# EasyEDA Pro project ProPrj_Avaota A1 八核 AIoT 开发板_2024-05-20.epro, board PCB1 (continued)
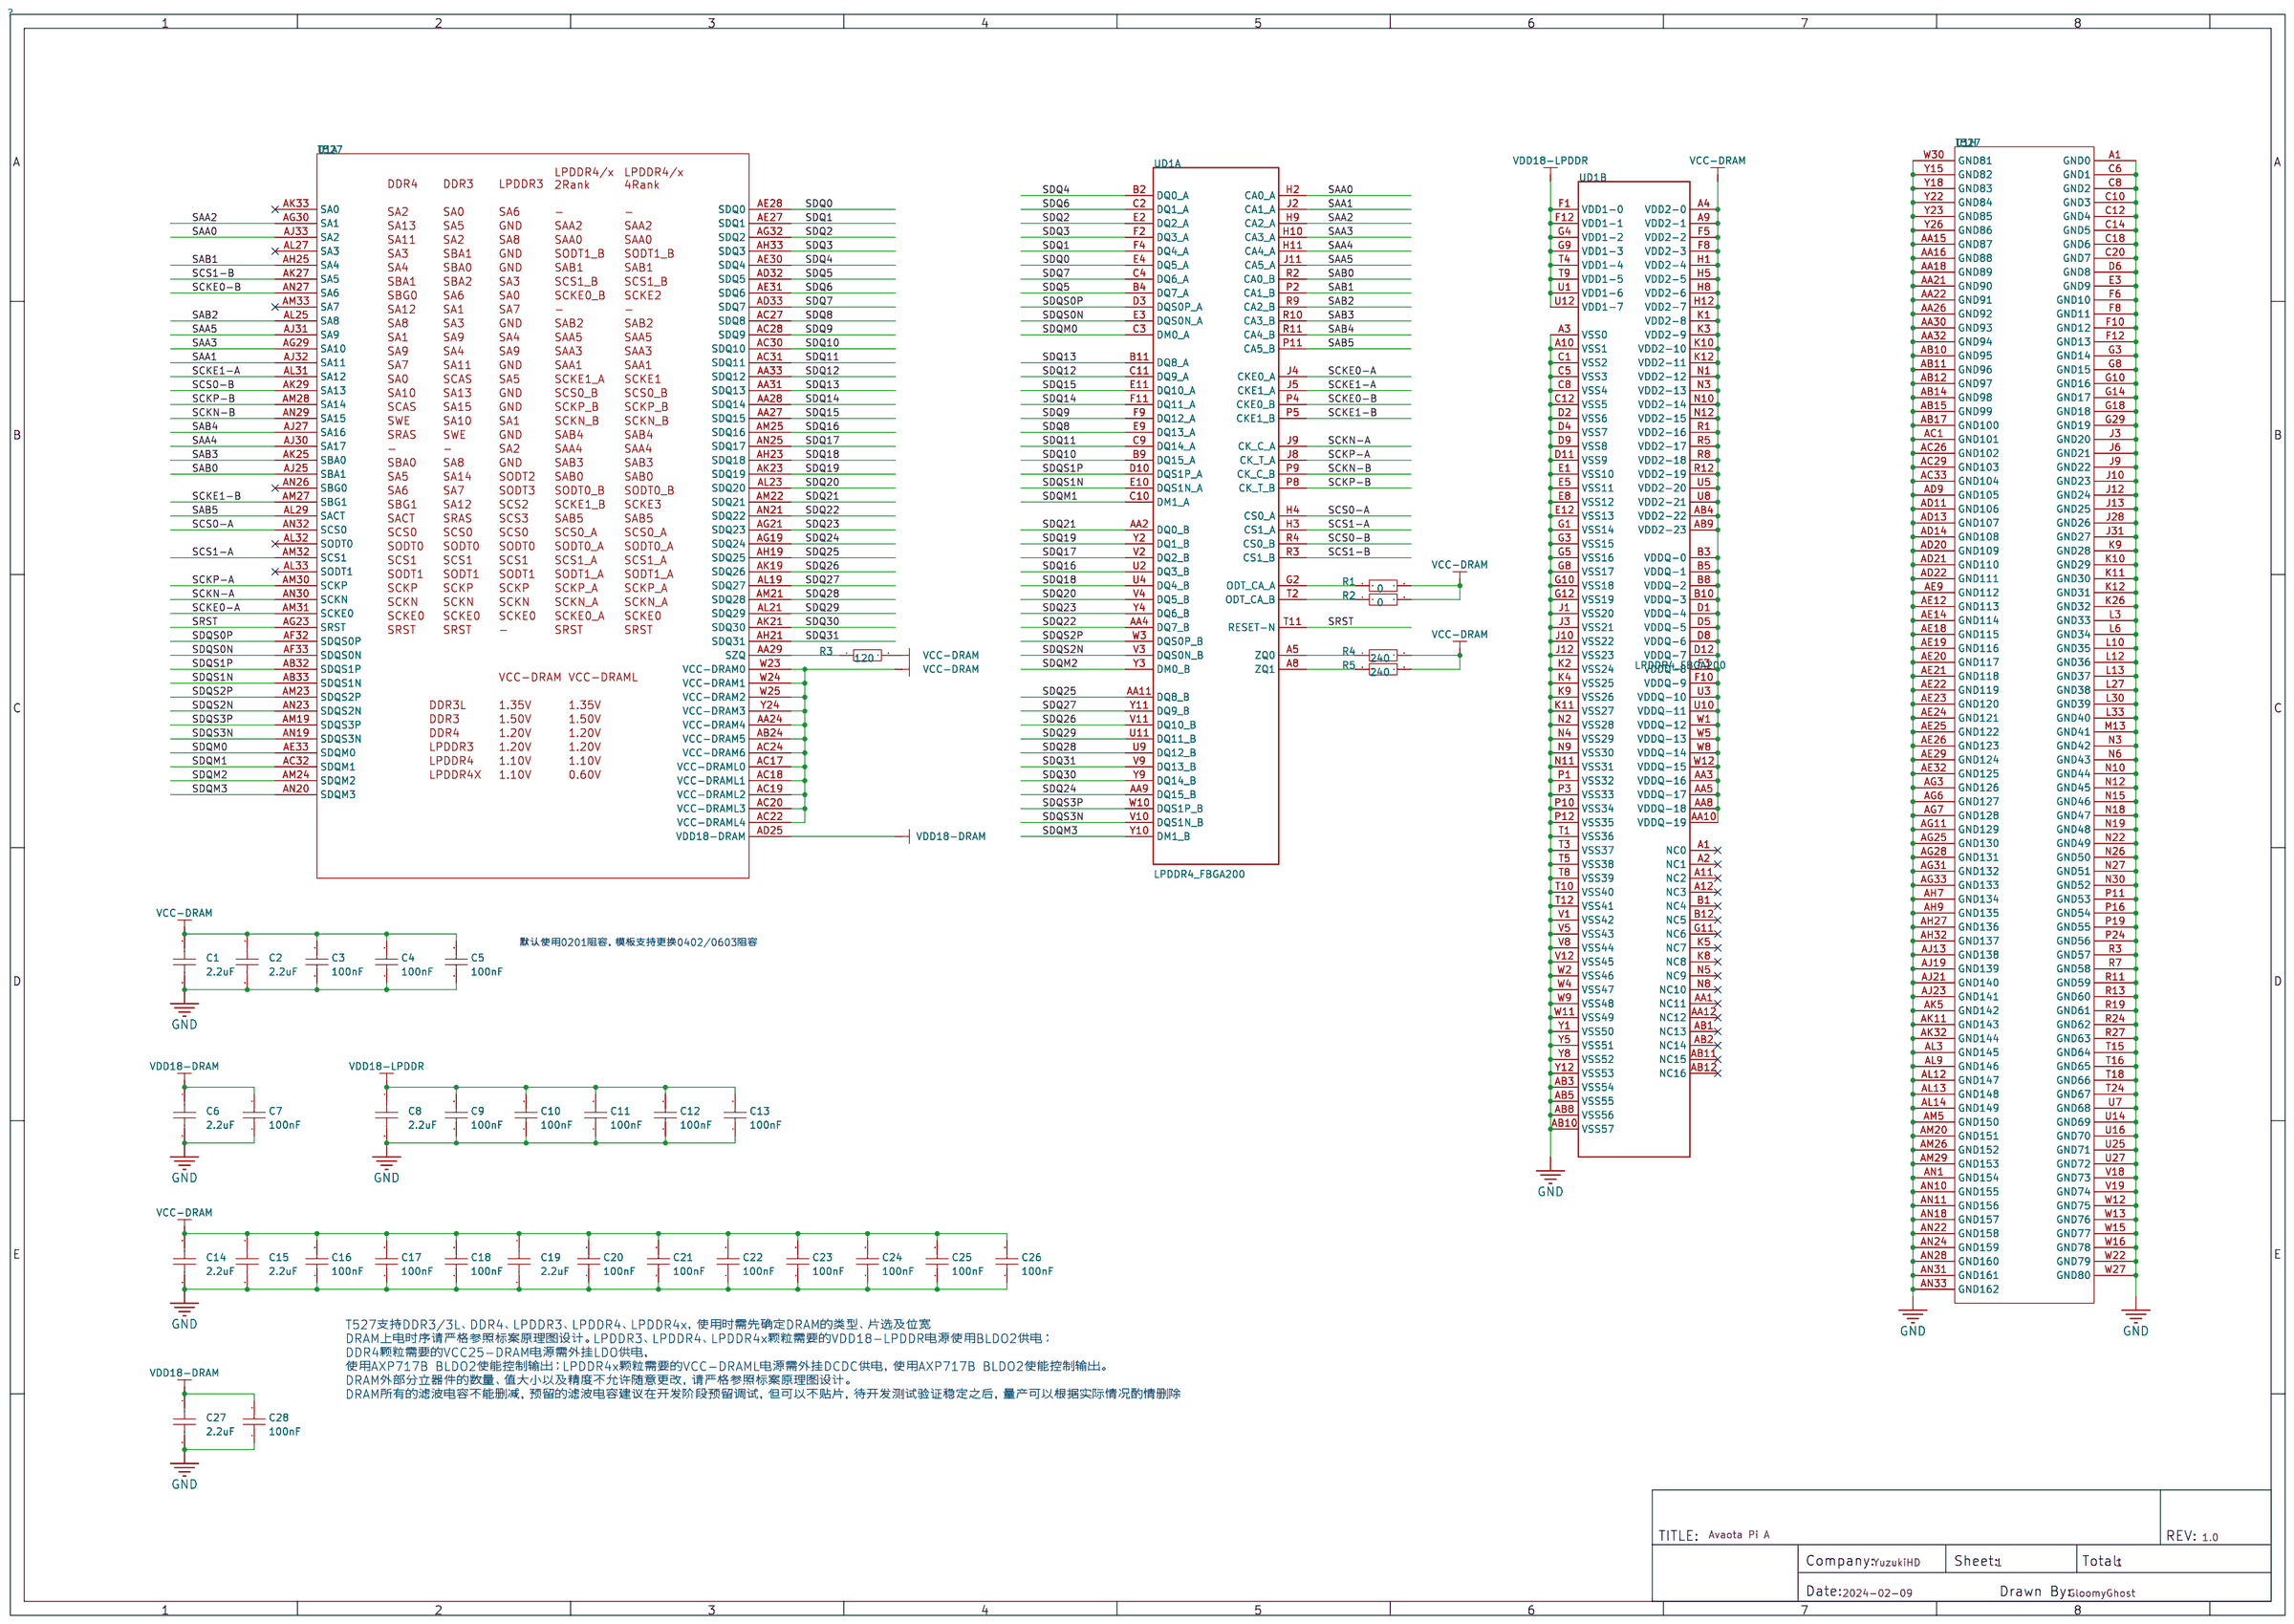
[diagram p0: schematic sheet]
## Routing (per net, layer and track width the routed paths; a pad name or vN(x,y) marks a point on that pad's centre or on a via; arc(x,y) is an arc through that point) (continued)
SDQ3: length 21.4
  Top Layer w0.076: 55.93,40.14 55.7,39.9 55.02,39.9 54.69,39.57 54.48,39.57 v2(53.92,39.01)
  Top Layer w0.115: v2(45.44,39.01) 45.49,39.06 45.49,39.37 45.34,39.52 44.8,39.52 44.68,39.65 44.68,39.93 44.8,40.06 45.79,40.06 46.12,40.39 46.12,40.97 45.74,41.35 45.02,41.35 43.87,42.49 43.39,42.49 43.18,42.71 43.06,42.71 42.95,42.82 42.95,43.21 42.29,43.87 41.72,43.87 41.41,43.55
  内层2 w0.115: v2(45.44,39.01) 45.81,38.64 53.55,38.64 v2(53.92,39.01)
SDQ4: length 18.8
  Top Layer w0.115: 57.43,41.64 57.9,41.64 v2(57.94,41.68) ; 41.41,40.95 41.74,40.61 42.31,40.61 43,39.93 43.68,39.93 v2(44.04,40.29)
  内层2 w0.115: v2(57.94,41.68) 57.83,41.68 57.43,41.27 57.43,40.69 56.69,39.95 53.57,39.95 53.49,40.03 50.7,40.03 50.49,40.23 44.1,40.23 v2(44.04,40.29)
SDQ5: length 21.1
  Top Layer w0.076: 57.93,40.64 57.68,40.39 57.68,40.04 57.55,39.91 57.55,39.42 v2(57.14,39)
  Top Layer w0.115: 40.17,40.62 40.16,40.64 40.11,40.64 39.81,40.95
  内层2 w0.115: v2(57.14,39) 57.14,38.95 55.99,37.8 43.2,37.8 40.42,40.58 40.22,40.58 v2(40.17,40.62)
SDQ6: length 20.8
  Top Layer w0.115: 41.41,41.6 41.75,41.25 42.4,41.25 42.57,41.08 42.57,40.77 42.67,40.67 42.82,40.67 42.9,40.74 42.9,41.13 43.01,41.25 43.14,41.25 43.25,41.13 43.25,40.74 43.34,40.66 43.51,40.66 43.58,40.73 43.58,41.17 43.66,41.25 43.79,41.25 43.89,41.15 43.89,40.67 43.51,40.29 v2(43.36,40.29) ; 57.43,41.14 57.4,41.1 v2(56.97,41.1)
  内层2 w0.115: v2(43.36,40.29) 43.73,40.67 50.95,40.67 51.28,40.33 53.77,40.33 53.92,40.18 56.41,40.18 56.97,40.74 v2(56.97,41.1)
SDQ7: length 23.5
  Top Layer w0.076: v2(57.65,39) 57.65,39.13 57.76,39.24 57.76,39.86 57.86,39.96 57.86,40.07 57.93,40.14
  Top Layer w0.115: 39.81,41.6 39.74,41.6 v2(39.44,41.3)
  内层2 w0.115: v2(57.65,39) 57.65,38.85 56.18,37.38 41.79,37.38 39.5,39.67 39.5,40 39.77,40.28 39.77,40.97 v2(39.44,41.3)
SDQ8: length 28.1
  Top Layer w0.115: 58.43,43.14 58.69,42.88 v2(58.85,42.88) ; UD1.E9 36.35,42.57 36.8,42.57 37.16,42.52 37.49,42.57 v2(37.77,42.87)
  Inner5 w0.115: v2(58.85,42.88) 58.46,42.88 58.34,42.77 58.34,42.29 58.11,42.06 56.82,42.06 56.51,41.76 56.51,40.89 56.38,40.76 52.35,40.76 51.51,41.6 46.97,41.6 46.25,42.32 44.22,42.32 43.91,42.62 43.67,42.62 43.55,42.51 43.55,42.43 43.44,42.32 43.21,42.32 43.09,42.43 43.09,42.51 42.98,42.62 42.36,42.62 42.19,42.44 41.68,42.44 41.2,42.93 41.2,43.34 41.08,43.46 40.85,43.46 40.74,43.34 40.74,43.07 40.63,42.95 39.85,42.95 39.77,42.87 39.14,42.87 38.68,43.33 38.22,43.33 v2(37.77,42.87)
SDQ9: length 28.1
  Top Layer w0.115: 35.81,43.55 35.89,43.46 36.23,43.46 36.46,43.23 37.95,43.23 38.17,43 38.17,42.32 v2(38.56,41.94) ; v2(58.82,42.36) 58.72,42.36 58.43,42.64
  Inner5 w0.115: v2(38.56,41.94) 38.56,42.15 38.67,42.27 39.62,42.27 40.16,41.73 40.99,41.73 41.81,40.92 41.81,40.78 41.92,40.67 42.47,40.67 42.95,41.15 44.06,41.15 44.47,41.55 45.38,41.55 45.49,41.44 45.49,41.3 45.62,41.17 45.74,41.17 45.98,41.41 46.14,41.41 46.78,40.77 51.46,40.77 51.92,40.31 57.68,40.31 58.29,40.92 58.29,41.68 58.82,42.21 v2(58.82,42.36)
SDQ10: length 26.9
  Top Layer w0.076: v2(58.9,41.64) 58.44,41.64 58.43,41.64
  Top Layer w0.115: v2(37.87,40.56) 37.56,40.26 37.06,40.26 36.7,40.61 36.14,40.61 35.81,40.95
  Inner5 w0.115: v2(37.87,40.56) 37.87,40.8 37.98,40.92 39.65,40.92 39.7,40.97 40.59,40.97 40.64,40.92 41.25,40.92 41.43,40.74 41.43,40.4 41.54,40.28 42.68,40.28 43.12,40.73 44.58,40.73 44.69,40.84 44.69,41.06 44.81,41.17 45.03,41.17 45.15,41.06 45.15,40.84 45.26,40.73 46.32,40.73 46.7,40.35 51.29,40.35 51.56,40.08 57.99,40.08 58.52,40.61 58.52,41.33 58.83,41.64 v2(58.9,41.64)
SDQ11: length 26.1
  Top Layer w0.115: v2(58.9,41.1) 58.47,41.1 58.43,41.14 ; v2(38.53,40.56) 38.15,40.94 37.59,40.94 37.28,41.25 36.15,41.25 35.81,41.6
  Inner5 w0.115: v2(38.53,40.56) 38.81,40.56 38.92,40.45 38.92,40.32 39.29,39.96 39.45,39.96 39.7,40.21 40.74,40.21 41.02,39.93 44.37,39.93 44.47,40.03 44.47,40.27 44.59,40.38 44.91,40.38 45.08,40.21 45.51,40.21 45.62,40.31 46.14,40.31 46.25,40.2 46.25,40.03 46.35,39.93 51.14,39.93 51.21,39.85 58.14,39.85 58.9,40.61 v2(58.9,41.1)
SDQ12: length 32.7
  Top Layer w0.115: v2(59.5,39.57) 59.43,39.64 59.43,40.14 ; v2(33.3,39.78) 33.71,40.18 33.71,41.1 34.21,41.6
  Inner5 w0.115: v2(59.5,39.57) 59.76,39.57 60.22,39.12 60.22,38.76 59.84,38.38 59.84,38.12 59.09,37.38 35.7,37.38 v2(33.3,39.78)
SDQ13: length 31.5
  Top Layer w0.076: 59.43,41.14 59.18,40.89 59.18,39.75 59.13,39.7 59.13,39.45 59.27,39.31 ; v2(59.83,38.94) 59.42,39.25 59.27,39.31 ; 59.27,39.31 arc(59.27,39.31) 59.27,39.3
  Top Layer w0.115: v2(34.19,39.78) 33.91,40.05 33.91,40.65 34.21,40.95
  Inner5 w0.115: v2(34.19,39.78) 34.19,39.4 35.79,37.79 59.1,37.79 59.54,38.23 59.54,38.46 59.83,38.75 v2(59.83,38.94)
SDQ14: length 32.5
  Top Layer w0.102: 59.43,42.64 59.89,42.64 v2(59.9,42.65)
  Top Layer w0.115: 34.21,43.55 34.21,43.51 v2(33.88,43.18)
  Inner5 w0.115: v2(59.9,42.65) 59.54,42.29 59.54,40.31 58.62,39.4 52.5,39.4 52.19,39.09 45.9,39.09 45.59,39.4 45.29,39.4 44.98,39.09 37.89,39.09 36.19,40.79 36.19,42.29 35.48,43.01 34.93,43.01 34.85,42.93 34.14,42.93 33.88,43.18
SDQ15: length 31.8
  Top Layer w0.115: 59.43,43.14 59.47,43.18 v2(59.94,43.18) ; 34.21,42.9 34.59,43.28 v2(34.62,43.28)
  Inner5 w0.115: v2(34.62,43.28) 35.66,43.28 36.6,42.34 36.6,40.92 38.02,39.5 44.8,39.5 45.11,39.81 45.76,39.81 46.07,39.51 52.08,39.51 52.19,39.62 58.42,39.62 59.26,40.46 59.26,42.6 59.84,43.18 v2(59.94,43.18)
SDQ16: length 16.7
  Top Layer w0.076: 51.91,43.57 52.91,43.57 53.23,43.89 53.68,43.89 53.93,44.14
  Top Layer w0.115: 51.91,43.57 51.79,43.46 49.27,43.46 v2(47.27,45.47) ; v2(43.38,50.22) 43.26,50.57 43.13,50.75 43.08,50.85 42.85,50.95 42.6,50.9 42.32,51 41.73,50.98 41.71,50.95 UD1.U2
  内层2 w0.115: v2(47.27,45.47) 47.27,45.48 46.04,46.71 46.04,47.64 43.46,50.22 v2(43.38,50.22)
SDQ17: length 16.5
  Top Layer w0.115: v2(43.33,51.36) 43,51.69 41.74,51.69 41.41,51.35 ; v2(48,45.47) 48.03,45.44 48.03,45.26 49.58,43.71 51.69,43.71 51.86,43.89 52.88,43.89 53.13,44.14 53.43,44.14
  内层2 w0.115: v2(48,45.47) 47.88,45.47 46.45,46.89 46.45,47.81 43.33,50.94 v2(43.33,51.36)
SDQ18: length 24.1
  Top Layer w0.076: v2(56.01,44.68) 55.93,44.75 55.93,45.14
  Top Layer w0.115: v2(39.4,51.08) 39.78,50.7 39.81,50.7
  内层2 w0.115: v2(56.01,44.68) 56.01,44.83 55.54,45.3 54.29,45.3 53.62,45.97 53.62,46.35 51.84,48.13 51.46,48.13 46.2,53.39 39.39,53.39 39.14,53.14 39.14,51.34 v2(39.4,51.08)
SDQ19: length 18.9
  Top Layer w0.115: 54.93,45.14 54.96,45.11 v2(54.96,44.68) ; v2(46.73,51.79) 46.06,51.12 43.97,51.12 43.72,51.36 43.72,52.49 43.25,52.96 41.85,52.96 41.54,52.65 41.41,52.65
  内层2 w0.115: v2(46.73,51.79) 46.73,51.78 50.2,48.31 50.54,48.31 53.36,45.49 53.49,45.49 53.92,45.06 54.68,45.06 54.96,44.78 v2(54.96,44.68)
SDQ20: length 21.2
  Top Layer w0.076: v2(39.5,52.98) 39.5,51.66 39.81,51.35
  Top Layer w0.102: 54.43,45.14 v2(54.43,44.68)
  内层2 w0.115: v2(39.5,52.98) 39.52,53.01 45.9,53.01 46.31,52.59 46.31,51.61 50.01,47.92 50.34,47.92 53.02,45.24 53.36,45.24 53.92,44.68 v2(54.43,44.68)
SDQ21: length 17.3
  Top Layer w0.076: v2(51.97,45.47) 52.3,45.8 53.21,45.8 53.31,45.89 53.68,45.89 53.93,45.64
  Top Layer w0.115: 41.41,53.3 41.49,53.3 41.91,53.72 41.91,54.05 42.11,54.25 42.44,54.25 42.85,53.85 43.63,53.85 45.62,51.87 45.73,51.87 45.84,51.75 v2(45.84,51.66)
  内层2 w0.115: v2(45.84,51.66) 45.84,51.48 49.83,47.5 50.11,47.5 51.97,45.64 v2(51.97,45.47)
SDQ22: length 20.7
  Top Layer w0.076: 53.43,46.14 53.3,46.14 53.15,45.99 51.6,45.99
  Top Layer w0.115: v2(51.38,45.47) 51.43,45.47 51.46,45.49 51.46,45.85 51.6,45.99 ; 39.81,53.3 40.16,53.65 40.16,54.51 40.64,54.99 42.8,54.99 43.56,54.23 43.74,54.23 45.41,52.55 v2(45.82,52.55)
  内层2 w0.115: v2(45.82,52.55) 45.43,52.16 45.43,51.31 49.66,47.08 49.94,47.08 51.38,45.63 v2(51.38,45.47)
SDQ23: length 22.2
  Top Layer w0.102: 56.43,46.14 56.43,45.89 ; 56.43,45.89 56.43,45.82 56.53,45.72 v2(56.55,45.72) ; 56.43,45.89 56.43,46.14
  Top Layer w0.115: 39.81,52.65 40,52.65 40.31,52.96 40.71,52.96 40.99,53.24 40.99,53.31 41.3,53.62 41.5,53.62 41.7,53.82 41.7,54.15 42.11,54.56 42.59,54.56 42.69,54.46 v2(42.82,54.46)
  内层2 w0.115: v2(56.55,45.72) 56.12,46.15 54.4,46.15 51.97,48.59 51.59,48.59 45.72,54.46 v2(42.82,54.46)
SDQ24: length 25.9
  Top Layer w0.102: 56.43,47.14 56.43,46.78 v2(56.54,46.68)
  Top Layer w0.115: v2(36.17,53.7) 36.17,53.66 35.81,53.3
  Inner5 w0.115: v2(36.17,53.7) 36.24,53.77 36.6,53.77 36.88,54.05 36.88,54.46 37.41,54.99 45.37,54.99 49.38,50.99 49.38,50.83 51.51,48.69 54.2,48.69 54.51,48.39 54.51,48.37 55.23,47.65 55.78,47.65 56.54,46.89 v2(56.54,46.68)
SDQ25: length 27.2
  Top Layer w0.115: v2(37.69,54.61) 37.39,54.91 35.13,54.91 34.57,54.36 34.57,53.66 34.21,53.3 ; 56.01,47.07 v2(56.01,46.68) ; 56.01,47.07 55.93,47.14
  Inner5 w0.115: v2(37.69,54.61) 38.07,54.23 38.81,54.23 39.04,54.46 40.36,54.46 40.73,54.09 45.68,54.09 48.96,50.81 48.96,50.58 51.13,48.41 53.87,48.41 55.01,47.27 55.52,47.27 56.01,46.79 v2(56.01,46.68)
SDQ26: length 27
  Top Layer w0.102: v2(54.96,46.68) 54.93,46.71 54.93,47.14
  Top Layer w0.115: 34.21,51.35 34.57,51.71 v2(34.57,51.71)
  Inner5 w0.115: v2(54.96,46.68) 54.96,46.73 53.59,48.11 50.84,48.11 48.54,50.41 48.54,50.52 45.39,53.67 40.66,53.67 40.31,54.03 39.09,54.03 38.96,53.9 38.02,53.9 37.79,53.67 36.96,53.67 36.58,53.29 35.18,53.29 35.05,53.42 34.44,53.42 34.21,53.19 34.21,52.07 v2(34.57,51.71)
SDQ27: length 24.4
  Top Layer w0.115: v2(34.59,53.01) 34.57,53.01 34.21,52.65 ; 54.43,47.14 v2(54.43,46.68)
  Inner5 w0.115: v2(54.43,46.68) 53.77,47.35 51.01,47.35 46.95,51.41 46.56,51.41 46.3,51.66 46.3,51.79 46,52.1 45.62,52.1 44.49,53.23 41.95,53.23 41.81,53.37 40.46,53.37 40.1,53.72 39.22,53.72 39.11,53.62 38.07,53.62 37.82,53.37 37.54,53.37 37.41,53.24 37.41,52.98 37.26,52.83 34.77,52.83 v2(34.59,53.01)
SDQ28: length 21.8
  Top Layer w0.076: 51.16,46.33 51.53,46.33 51.69,46.18 53.11,46.18 53.32,46.39 53.68,46.39 53.93,46.14
  Top Layer w0.115: 51.16,46.33 50.37,46.33 50.09,46.05 49.3,46.05 49.15,45.9 48.33,45.9 47.27,46.96 v2(47.27,47.2) ; v2(37.64,50.75) 37.03,50.75 36.75,51.03 36.29,51.03 35.97,50.7 35.81,50.7
  Inner5 w0.115: v2(37.64,50.75) 37.64,50.41 37.75,50.29 38.83,50.29 39.16,49.96 39.62,49.96 39.88,50.22 40.49,50.22 40.69,50.01 41.48,50.01 41.55,49.94 42.03,49.94 42.54,49.43 43.12,49.43 43.47,49.07 43.86,49.07 44.09,49.3 44.39,49.3 44.99,48.7 46.09,48.7 46.63,48.16 46.63,47.82 47.26,47.2 v2(47.27,47.2)
SDQ29: length 25
  Top Layer w0.115: v2(33.8,50.95) 34.06,50.7 34.21,50.7 ; 54.43,46.14 v2(54.43,45.68)
  Inner5 w0.115: v2(54.43,45.68) 53.96,45.68 53.76,45.88 52.59,45.88 52.18,46.29 48.19,46.29 47.78,46.71 47.14,46.71 45.57,48.29 44.3,48.29 43.93,48.65 43.3,48.65 42.95,49.01 42.45,49.01 41.91,49.56 41.43,49.56 41.25,49.73 40.59,49.73 40.36,49.96 40,49.96 39.78,49.73 39.04,49.73 38.81,49.5 36.68,49.5 36.5,49.33 34.3,49.33 34.19,49.44 34.19,50.57 v2(33.8,50.95)
SDQ30: length 23.2
  Top Layer w0.102: v2(38.48,52.55) 38.45,52.58 37.72,52.58 37.36,52.93 36.96,52.86 36.78,52.93 36.4,52.93 36.22,52.76 35.91,52.76 35.81,52.65 ; 54.93,46.14 54.93,45.71 v2(54.96,45.68)
  Inner5 w0.115: v2(54.96,45.68) 54.59,46.05 53.95,46.05 53.74,46.25 52.65,46.25 52.25,46.66 50.51,46.66 46.72,50.44 45.81,50.44 44.29,51.97 41.65,51.97 41.4,52.22 41.4,52.55 41.22,52.73 40.49,52.73 40.23,52.48 39.04,52.48 38.96,52.55 v2(38.48,52.55)
SDQ31: length 24.9
  Top Layer w0.115: 35.81,51.35 36.13,51.35 36.47,51.68 37.31,51.68 37.79,52.17 v2(37.79,52.2) ; v2(56.01,45.68) 56.01,46.07
  Inner5 w0.115: v2(56.01,45.68) 56.01,45.77 55.5,46.28 54.23,46.28 53.49,47.02 50.75,47.02 46.81,50.95 45.89,50.95 44.04,52.81 41.78,52.81 41.53,53.06 40.18,53.06 39.85,53.39 39.29,53.39 39.01,53.11 39.01,53.02 38.9,52.91 38.28,52.91 37.79,52.43 v2(37.79,52.2)
SDQM0: length 19.5
  Top Layer w0.076: v2(56.61,39) 57.35,39.74 57.39,39.97 57.43,40.15
  Top Layer w0.115: 40.61,41.6 40.89,41.31 v2(40.89,41.27)
  内层2 w0.115: v2(56.61,39) 56.6,39 56.6,38.95 55.87,38.22 43.49,38.22 41.68,40.03 41.68,40.41 40.89,41.2 v2(40.89,41.27)
SDQM1: length 26.3
  Top Layer w0.115: 58.43,40.64 58.43,40.65 v2(57.94,41.15) ; v2(37.89,41.94) 37.77,41.81 37.01,41.81 36.9,41.91 35.63,41.91 35.32,41.6 35.01,41.6
  Inner5 w0.115: v2(37.89,41.94) 37.74,42.09 37.74,42.32 38.05,42.62 39.65,42.62 40.13,42.14 41.09,42.14 42.06,41.17 42.44,41.17 42.83,41.56 43.98,41.56 44.35,41.94 46.15,41.94 46.9,41.19 51.55,41.19 52.19,40.54 57.33,40.54 v2(57.94,41.15)
SDQM2: length 19.9
  Top Layer w0.076: 51.79,44.14 52.78,44.14 53.02,44.39 53.68,44.39 53.93,44.64
  Top Layer w0.115: 51.79,44.14 51.64,44.14 51.46,43.97 49.75,43.97 48.54,45.18 v2(48.54,45.47) ; 40.61,52.65 40.71,52.65 41.02,52.96 41.53,52.96 41.78,53.21 41.78,53.28 42.13,53.62 42.39,53.62 42.62,53.39 43.46,53.39 44.14,52.7 v2(44.14,51.54)
  内层2 w0.115: v2(44.14,51.54) 44.12,51.51 44.12,50.75 44.17,50.7 44.17,50.69 46.89,47.97 46.89,47.05 47.63,46.3 47.7,46.3 v2(48.54,45.47)
SDQM3: length 23.5
  Top Layer w0.076: 53.43,46.64 53.33,46.64 53.06,46.38 51.77,46.38 51.53,46.62
  Top Layer w0.115: 51.53,46.62 50.25,46.62 49.91,46.28 49.07,46.28 48.99,46.2 48.44,46.2 47.75,46.89 47.75,47.4 47.37,47.78 v2(47.27,47.78) ; 35.01,52.65 34.94,52.65 v2(34.62,52.32)
  Inner5 w0.115: v2(47.27,47.78) 47.01,48.03 47.01,48.29 46.17,49.12 45.16,49.12 44.43,49.85 42.65,49.85 42.31,50.19 42.31,50.39 41.96,50.75 40.66,50.75 40.49,50.57 39.77,50.57 39.62,50.72 38.81,50.72 38.43,51.1 37.44,51.1 37.16,50.83 35.66,50.83 35,51.49 35,51.94 v2(34.62,52.32)
SDQS0N: length 19.7
  Top Layer w0.076: 56.93,40.14 56.89,40.1 56.89,39.94 56.6,39.65 56.42,39.65 56.14,39.37 55.67,39.37 55.54,39.23 v2(55.54,39.03)
  Top Layer w0.097: v2(40.93,42.57) 40.61,42.9
  内层2 w0.127: v2(55.54,39.03) 55.54,39.18 55.03,39.69 52.26,39.69 52.09,39.52 48.54,39.52 48.33,39.73 43.23,39.73 42.53,40.43 42.53,40.68 41.22,42 40.8,42 40.63,42.18 40.63,42.45 40.75,42.57 v2(40.93,42.57)
SDQS0P: length 20.1
  Top Layer w0.076: 56.93,40.64 56.93,40.5 56.69,40.26 56.69,40.03 56.49,39.83 56.34,39.83 56.06,39.55 55.5,39.55 v2(54.98,39.03)
  Top Layer w0.127: v2(40.26,42.57) 40.58,42.25 40.61,42.25
  内层2 w0.127: v2(40.26,42.57) 40.33,42.5 40.33,42.06 40.68,41.71 41.1,41.71 42.24,40.56 42.24,40.31 43.11,39.44 48.21,39.44 48.42,39.23 52.21,39.23 52.38,39.4 54.61,39.4 v2(54.98,39.03)
SDQS1N: length 30.2
  Top Layer w0.076: v2(59.23,38.96) 58.93,39.26 58.93,40.14
  Top Layer w0.127: v2(34.69,42.57) 35.01,42.88 35.01,42.9
  Inner5 w0.127: v2(34.69,42.57) 34.69,42.57 34.8,42.47 34.8,42.19 35.01,41.97 35.01,39.46 36.17,38.3 58.88,38.3 59.18,38.59 59.18,38.91 v2(59.23,38.96)
SDQS1P: length 30.3
  Top Layer w0.076: 58.68,39.72 58.61,39.64 58.47,39.64 58.37,39.54 58.37,39.43 58.47,39.34 58.61,39.34 58.68,39.26 58.68,39.1 58.67,39.09 v2(58.67,38.96) ; 58.93,40.64 58.68,40.39 58.69,40.05 58.69,39.72
  Top Layer w0.127: v2(35.33,42.57) 35.01,42.25
  Inner5 w0.127: v2(58.67,38.96) 58.76,38.96 58.89,38.84 58.89,38.72 58.76,38.59 36.29,38.59 35.3,39.58 35.3,42.09 35.09,42.31 35.09,42.44 35.22,42.57 v2(35.33,42.57)
SDQS2N: length 18.8
  Top Layer w0.076: 50.53,44.6 52.2,44.6 52.78,45.19 53.1,45.19 53.17,45.11 53.17,45.03 53.25,44.95 53.36,44.95 53.43,45.03 53.43,45.14
  Top Layer w0.127: 40.61,51.35 40.99,51.74 v2(40.99,51.76) ; v2(49.66,45.47) 49.76,45.47 49.93,45.29 49.93,44.93 50.26,44.6 50.53,44.6
  内层2 w0.127: v2(40.99,51.76) 40.99,51.83 41.12,51.96 41.28,51.96 41.49,51.74 43.53,51.74 43.9,52.11 44.36,52.11 44.63,51.83 44.63,50.95 47.69,47.89 47.69,47.03 48.79,45.92 49.72,45.92 49.9,45.74 49.9,45.61 49.76,45.47 v2(49.66,45.47)
SDQS2P: length 18.8
  Top Layer w0.076: 53.93,45.14 53.68,45.39 52.7,45.39 52.11,44.81 50.8,44.81 50.69,44.91 50.59,44.91
  Top Layer w0.127: 50.59,44.91 50.58,44.91 50.32,44.91 50.19,45.03 50.19,45.41 v2(50.24,45.47) ; 40.61,52 40.95,52.34 40.98,52.34 v2(40.99,52.35)
  内层2 w0.127: v2(50.24,45.47) 50.19,45.52 50.19,45.87 49.84,46.21 48.91,46.21 47.98,47.15 47.98,48.01 44.92,51.07 44.92,51.96 44.48,52.4 43.78,52.4 43.41,52.03 41.62,52.03 41.4,52.25 41.09,52.25 v2(40.99,52.35)
SDQS3N: length 22.2
  Top Layer w0.076: 53.43,47.14 52.5,47.14 52.42,47.07 52.42,46.89 52.35,46.82 52.2,46.82 52.12,46.89 52.12,47.07 52.04,47.14 51.57,47.14
  Top Layer w0.127: v2(35.35,51.69) 35.01,51.35 35.01,51.35 ; 51.57,47.14 48.99,47.14 v2(48.75,46.9)
  Inner5 w0.127: v2(35.35,51.69) 35.35,51.82 35.48,51.94 35.68,51.94 35.92,51.7 37.22,51.7 37.38,51.54 38.05,51.54 38.38,51.87 39.8,51.87 40.56,51.1 42.01,51.1 42.47,50.65 44.4,50.65 45.41,49.63 46.41,49.63 47.65,48.4 47.65,47.55 48.14,47.05 48.58,47.05 48.73,46.9 v2(48.75,46.9)
SDQS3P: length 22.1
  Top Layer w0.076: 53.93,47.14 53.82,47.14 53.57,47.39 53.2,47.39 53.15,47.35 51.72,47.35 51.67,47.4 51.57,47.4
  Top Layer w0.127: 51.57,47.4 48.76,47.4 v2(48.74,47.41) ; 35.01,52 35.03,52 v2(35.41,52.37)
  Inner5 w0.127: v2(35.41,52.37) 35.55,52.23 35.8,52.23 36.04,51.99 37.34,51.99 37.5,51.83 37.93,51.83 38.26,52.16 39.92,52.16 40.68,51.4 42.1,51.4 42.56,50.94 44.52,50.94 45.53,49.92 46.54,49.92 47.94,48.52 47.94,47.67 48.26,47.35 48.67,47.35 v2(48.74,47.41)
SPI0-CLK: length 19.1
  Top Layer w0.102: v3(58.42,63.45) 57.89,63.98 57.89,65 58.27,65.38 58.75,65.38 58.95,65.58 59.03,65.58 arc(59.17,65.64) 59.22,65.77 59.22,66.08 arc(59.41,66.27) 59.6,66.08 59.6,65.77 arc(59.79,65.58) 59.98,65.77 59.98,66.08 arc(60.17,66.27) 60.36,66.08 60.36,65.77 arc(60.56,65.58) 60.75,65.77 60.75,66.08 arc(60.94,66.27) 61.13,66.08 61.13,65.77 arc(61.18,65.64) 61.32,65.58 64.26,65.58 64.82,65.02 64.82,64.41 65.23,64.01 65.23,59.6 R123.1
  Bottom Layer w0.102: v3(58.42,63.45) 58.14,63.73 57.49,63.73
SPI0-CS: length 20.7
  Top Layer w0.076: 64.94,55.14 65.2,55.4 65.2,56.88 65.53,57.22 65.53,58.62 65.68,58.77 65.68,58.9
  Top Layer w0.102: v3(63.68,66.4) 63.25,66.83 61.85,66.83 61.72,66.7 61.72,66.37 61.85,66.24 63.09,66.24 63.37,65.96 64.49,65.96 65.13,65.33 65.13,64.67 65.48,64.31 65.48,59.89 65.68,59.69 65.68,58.9
  Bottom Layer w0.102: 65.42,66.4 65.55,66.27 ; 65.42,66.4 v3(63.68,66.4) ; 65.42,66.4 65.09,66.73 R73.1
SPI0-HOLD: length 15.9
  Top Layer w0.076: 63.44,55.64 63.88,56.08 63.88,58.09 64.24,58.45 64.24,58.99
  Top Layer w0.102: v3(58.62,64.59) 60.02,63.2 63.3,63.2 64.24,62.26 64.24,58.99
  Bottom Layer w0.102: R75.1 57.47,65.01 57.49,65 58.22,65 v3(58.62,64.59)
SPI0-MISO: length 16.7
  Top Layer w0.076: 64.72,58.11 64.34,57.73 64.34,56.25 64.44,56.15 ; 64.72,58.11 64.72,58.8
  Top Layer w0.102: v3(63.73,64.47) 63.47,64.47 63.37,64.36 63.37,64.01 64.72,62.66 64.72,58.8
  Bottom Layer w0.102: v3(63.73,64.47) 63.7,64.47 63.47,64.69 63.47,65.79 63.6,65.91 63.75,65.91 63.88,65.79 63.88,64.82 63.96,64.74 64.1,64.74 64.19,64.82 64.19,65.79 64.28,65.88 64.4,65.88 64.49,65.79 64.49,64.77 64.8,64.47 65.46,64.47 65.55,64.56 65.55,65
SPI0-MOSI: length 20.7
  Top Layer w0.076: 64.44,55.65 64.44,55.79 64.7,56.05 64.7,56.24 64.54,56.39 64.54,57.61 64.96,58.03 64.96,58.85
  Top Layer w0.102: 64.96,58.85 64.96,63.72 64.47,64.21 64.47,64.82 64.03,65.25 63.17,65.25 62.26,64.34 60.5,64.34 59.77,65.08 58.37,65.08 58.17,64.87 58.17,64.21 58.88,63.5 v3(58.88,63.07)
  Bottom Layer w0.102: 57.49,62.46 58.27,62.46 v3(58.88,63.07)
SPI0-WP: length 19.5
  Top Layer w0.076: 63.94,55.64 64.1,55.8 64.1,57.99 64.47,58.37 64.47,58.98
  Top Layer w0.102: v3(64.24,63.75) 64.08,63.91 64.08,64.62 63.83,64.87 63.35,64.87 63.04,64.57 63.04,63.91 64.47,62.48 64.47,58.98
  Bottom Layer w0.102: v3(64.24,63.75) 63.93,63.75 63.55,63.37 63.55,62.18 63.68,62.05 63.88,62.05 63.98,62.16 63.98,63.17 64.11,63.3 64.31,63.3 64.54,63.07 65.71,63.07 65.86,63.22 65.86,63.42 65.55,63.73 66.74,63.73 R74.1
SPI-LCD-BLK: length 92.5
  Top Layer w0.102: U14.AN9 52.81,52.78 v1(52.45,52.78)
  内层2 w0.127: v1(46.76,64.26) 46.91,64.26 47.19,64.54 47.19,65.35 49.05,67.21 53.39,67.21 58.29,62.31 62.13,62.31 63.2,63.37 64.59,63.37 64.87,63.65 89.56,63.65 92.91,60.3 v1(92.91,54.1)
  Bottom Layer w0.102: H1.32 46.18,73.23 47.24,72.16 47.24,69.85 46.76,69.37 v1(46.76,64.26) 46.76,61.34 47.8,60.3 47.8,59.51 48.92,58.39 48.92,56.79 50.55,55.17 50.55,54.58 52.35,52.78 v1(52.45,52.78)
  Bottom Layer w0.127: U16.4 86.82,53.04 87.88,54.1 v1(92.91,54.1)
SPI-LCD-CLK: length 95.8
  Top Layer w0.102: U14.AJ9 54.94,52.65 v3(54.94,52.65)
  Top Layer w0.127: TFT1.4 92.91,44.89 v1(92.07,45.72)
  内层2 w0.127: v1(92.07,45.72) 92.05,45.75 92.05,47.65 91.41,48.29 91.41,48.82 92.53,49.94 92.53,53.11 92,53.65 92,60 89.08,62.92 65.41,62.92 65.1,62.61 63.78,62.61 62.74,61.57 57.78,61.57 52.88,66.47 49.66,66.47 47.98,64.8 47.98,63.7 v1(47.75,63.47)
  Bottom Layer w0.102: v3(54.94,52.65) 54.53,53.06 54.25,53.06 54.18,52.98 53.26,52.98 52.68,53.57 52.53,53.57 51.18,54.92 51.18,55.52 49.58,57.12 49.58,58.67 48.41,59.84 48.41,60.78 47.75,61.44 v1(47.75,63.47) 47.75,68.71 48.34,69.29 48.92,69.29 49.89,70.26 49.89,71.88 51.08,73.08 H1.36
SPI-LCD-CS: length 93.9
  Top Layer w0.102: U14.AK9 v3(54.43,52.65)
  Top Layer w0.127: TFT1.7 90.81,45.19 v1(90.91,45.29)
  内层2 w0.127: v1(90.91,45.29) 91.14,45.52 91.57,45.52 91.9,45.19 92.18,45.19 92.46,45.47 92.46,49.17 92.91,49.63 92.91,53.29 92.46,53.75 92.46,60.17 89.36,63.27 65.13,63.27 64.85,62.99 63.45,62.99 62.38,61.93 58.01,61.93 53.14,66.8 49.4,66.8 47.57,64.97 47.57,64.11 47.32,63.86 v1(47.24,63.86)
  Bottom Layer w0.102: v3(54.43,52.65) 53.16,52.65 52.65,53.16 52.48,53.16 50.88,54.76 50.88,55.37 49.25,57 49.25,58.52 48.11,59.66 48.11,60.53 47.24,61.39 v1(47.24,63.86) 47.24,69.06 48.54,70.36 48.54,70.69
SPI-LCD-DC: length 94.1
  Top Layer w0.102: v3(54.97,53.62) U14.AJ7
  Top Layer w0.127: TFT1.5 92.2,44.9 91.57,45.54 v1(91.57,46.18)
  内层2 w0.127: v1(48.72,62.69) 48.72,64.41 50.09,65.79 52.58,65.79 57.51,60.86 63.32,60.86 64.29,61.82 65.46,61.82 65.81,62.18 88.62,62.18 91.03,59.77 91.03,53.21 91.77,52.48 91.77,50.52 90.58,49.33 90.58,47.47 91.57,46.48 v1(91.57,46.18)
  Bottom Layer w0.076: v3(54.97,53.62) 54.64,53.95 54.28,53.95 54,53.67 53.52,53.67
  Bottom Layer w0.102: H1.38 52.91,72.52 52.88,72.52 52.43,72.06 52.43,69.98 51.84,69.39 50.52,69.39 49.48,68.35 49,68.35 48.72,68.07 v1(48.72,62.69) 48.72,61.54 49.05,61.21 49.05,60.15 50.29,58.9 50.29,57.46 51.82,55.93 51.82,55.37 53.52,53.67
SPI-LCD-MOSI: length 91.5
  Top Layer w0.102: v3(54.46,53.62) 54.47,53.62 U14.AK7
  Top Layer w0.127: v1(91.62,47.09) 93.6,45.1 TFT1.3
  内层2 w0.127: v1(91.62,47.09) 91.01,47.7 91.01,49.1 92.18,50.27 92.18,52.78 91.49,53.47 91.49,59.92 88.85,62.56 65.61,62.56 65.3,62.26 64.11,62.26 63.04,61.19 57.66,61.19 52.73,66.12 49.89,66.12 48.34,64.57 48.34,63.2 v1(48.21,63.07)
  Bottom Layer w0.102: v3(54.46,53.62) 54.1,53.26 53.49,53.26 52.81,53.95 52.65,53.95 51.49,55.12 51.49,55.73 49.94,57.28 49.94,58.8 48.72,60.02 48.72,61.06 48.21,61.57 v1(48.21,63.07) 48.21,68.43 48.64,68.86 49.23,68.86 51.05,70.69 51.08,70.69
SPI-LCD-RST: length 95
  Top Layer w0.076: v3(52.45,52.25) 52.96,52.25 53.31,51.89 53.69,51.89 U14.AM9
  Top Layer w0.127: v1(91.52,44.86) 91.52,42.37 TFT1.6
  内层2 w0.127: v1(91.52,44.86) 91.67,44.7 92.35,44.7 92.86,45.21 92.86,47.24 93.37,47.75 93.37,60.4 89.71,64.06 64.77,64.06 64.67,64.16 64.06,64.16 63.75,63.86 62.99,63.86 61.77,62.64 58.55,62.64 53.59,67.59 48.89,67.59 46.35,65.05 v1(46.35,64.74)
  Bottom Layer w0.102: v3(52.45,52.25) 50.24,54.46 50.24,55.09 48.62,56.72 48.62,58.29 47.55,59.36 47.55,60.05 46.35,61.24 v1(46.35,64.74) 46.35,70.33 46,70.69
SRST: length 27.9
  Top Layer w0.076: 56.43,45.14 56.43,44.87 56.54,44.76 56.54,44.68 v2(56.56,44.66)
  Top Layer w0.102: v2(34.63,50.27) 34.62,50.25 34.61,50.25 34.59,50.24 34.4,50.24 34.21,50.05
  内层2 w0.115: v2(56.56,44.66) 56.22,44.32 52.7,44.32 52.17,44.86 47.22,44.86 45.97,46.1 45.54,46.1 45.31,46.33 45.31,46.74 45.59,47.02 45.59,47.49 44.77,48.31 44.22,48.31 42.24,50.29 42.24,50.52 41.93,50.83 40.71,50.83 40.46,50.57 40,50.57 39.85,50.72 38.89,50.72 38.45,50.29 37.36,50.29 36.75,50.9 35.27,50.9 v2(34.63,50.27)
STWI1-SCK: length 27.6
  Top Layer w0.076: 53.92,54.63 53.69,54.4 52.54,54.4 51.99,54.94 51.99,55.85 51.26,56.59
  Top Layer w0.102: v1(46.86,57.48) 47.17,57.18 50.67,57.18 51.26,56.59
  Bottom Layer w0.102: H1.28 41.92,72.23 41.92,72.21 ; 41.92,72.21 42.24,71.88 42.24,70.13 43.18,69.19 43.18,67.06 45.54,64.69 45.54,60.88 46.76,59.66 46.76,57.58 v1(46.86,57.48) ; 41.92,72.21 41.63,72.49
STWI1-SDA: length 22.9
  Top Layer w0.076: 53.69,54.89 52.7,54.89
  Top Layer w0.102: v1(47.32,57.84) 47.68,57.48 50.9,57.48 52.32,56.06 52.32,55.27 52.7,54.89 ; U14.AM3 53.69,54.89
  Bottom Layer w0.102: v1(47.32,57.84) 47.19,57.96 47.19,59.77 45.9,61.06 45.9,64.77 43.51,67.16 43.51,70.64 43.46,70.69
UART1-CTS: length 54.7
  Top Layer w0.076: v3(19.66,61.21) 19.43,61.44 19.43,65.74 19.74,66.04 U9.41
  Top Layer w0.102: v3(61.95,53.65) U14.U6
  Inner5 w0.102: v3(19.66,61.21) 21.84,63.4 45.26,63.4 49.2,59.46 55.25,59.46 56.59,58.12 58.17,58.12 61.04,55.25 62.2,55.25 62.56,54.89 62.56,54.26 v3(61.95,53.65)